# EasyEDA Pro project 硬触发测试_2024-02-21_17-27-05(1).eprj, schematic Schematic1 (continued)
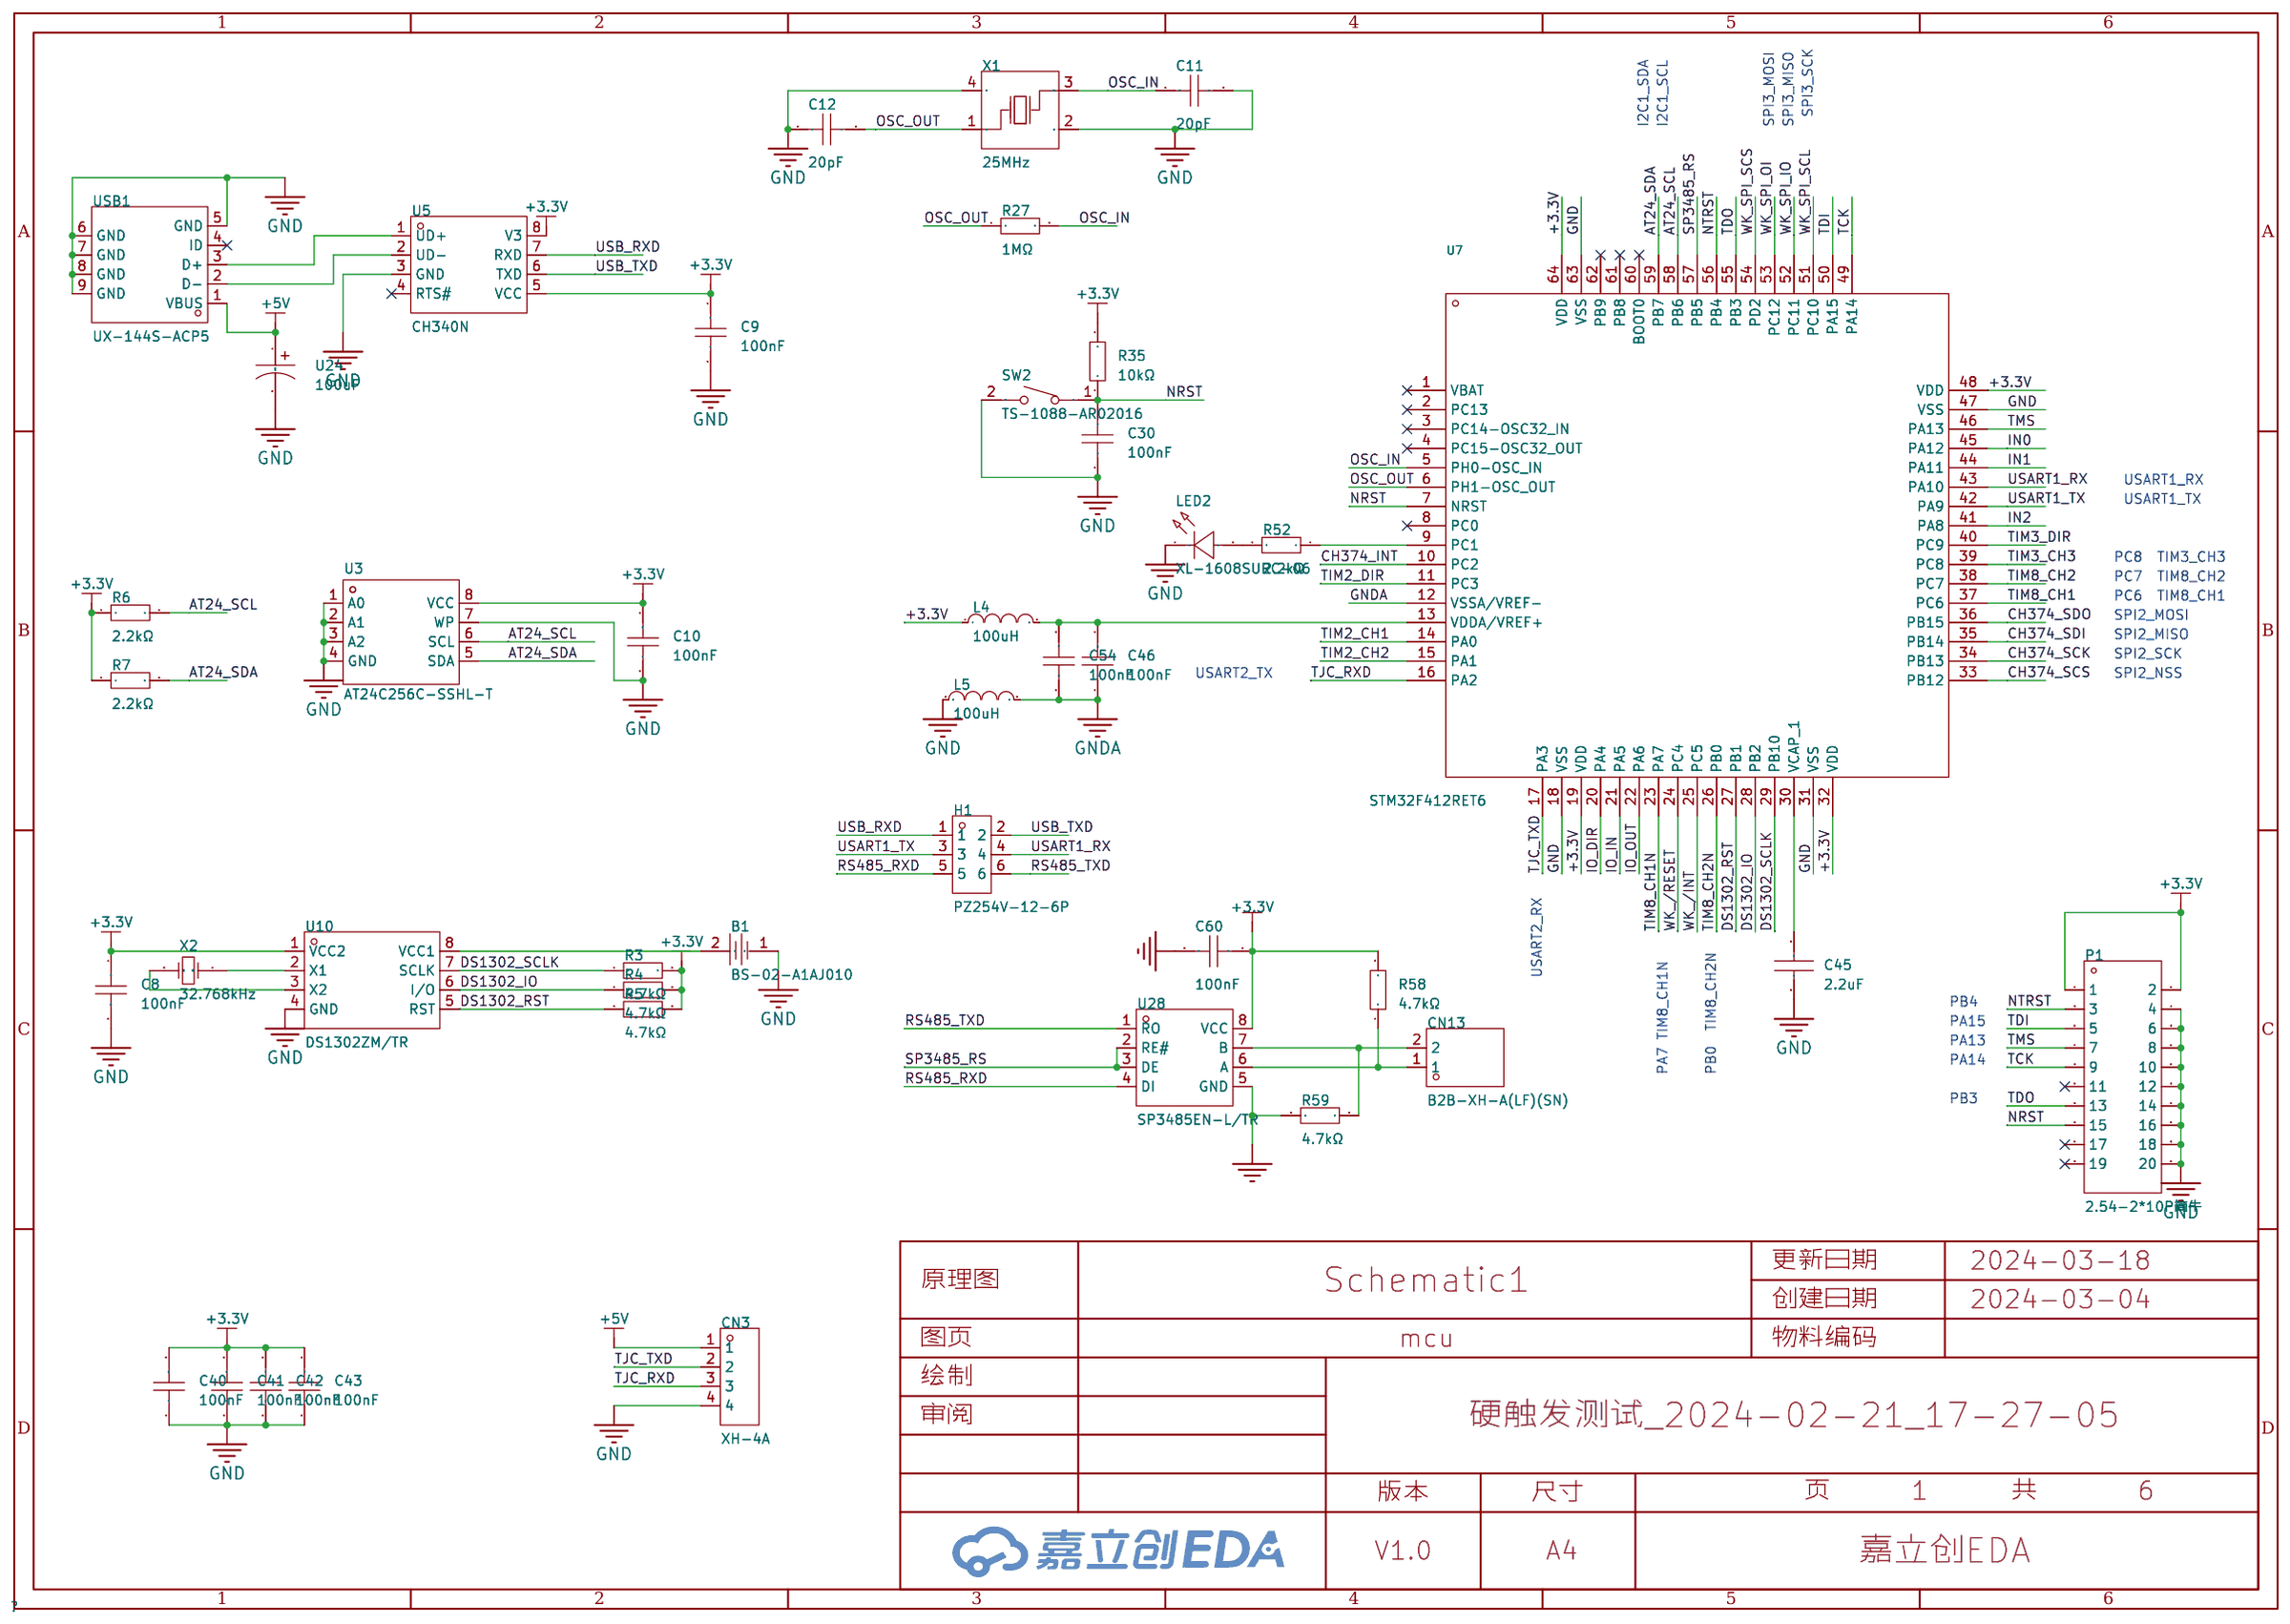
[diagram p0: mcu]
## Library data of the parts (continued)
P1 = 2.54-2*10P简牛: 连接器类型:简牛座;间距:2.54mm;封装形式:直插;行距:2.54mm;排数:2;触头材质:-;触头镀层:-;; LCSC Part Name: 2.54mm 排数:2; Supplier Part: C3405; Manufacturer: BOOMELE(博穆精密); Supplier Footprint: 插件,P=2.54mm; JLCPCB Part Class: 扩展库; Datasheet: https://atta.szlcsc.com/upload/public/pdf/source/20220902/F4C4645E59EE38C0F12B225613E1076A.pdf; Supplier: LCSC; Connector Type: 简牛座; Pitch: 2.54mm; Holder Type: 直插; Row Spacing: 2.54mm; Number of Rows: 2
R3-R5 R51 = 0603WAF4701T5E: 电阻类型:厚膜电阻;阻值:4.7kΩ;精度:±1%;功率:100mW;最大工作电压:75V;温度系数:±100ppm/℃;; LCSC Part Name: 4.7kΩ ±1% 100mW 厚膜电阻; Supplier Part: C23162; Manufacturer: UNI-ROYAL(厚声); Supplier Footprint: 0603; JLCPCB Part Class: 基础库; Datasheet: https://atta.szlcsc.com/upload/public/pdf/source/20200306/C422600_1E6D84923E4A46A82E41ADD87F860B5C.pdf; Supplier: LCSC; Type: 厚膜电阻; Tolerance: ±1%; Power(Watts): 100mW; Overload Voltage (Max): 75V; Temperature Coefficient: ±100ppm/℃; Operating Temperature Range: -55℃~+155℃
R6 R7 R42 R44-R49 R52 R55-R57 = 0603WAF2201T5E: 电阻类型:厚膜电阻;阻值:2.2kΩ;精度:±1%;功率:100mW;最大工作电压:75V;温度系数:±100ppm/℃;; LCSC Part Name: 2.2kΩ ±1% 100mW 厚膜电阻; Supplier Part: C4190; Manufacturer: UNI-ROYAL(厚声); Supplier Footprint: 0603; JLCPCB Part Class: 基础库; Datasheet: https://atta.szlcsc.com/upload/public/pdf/source/20200306/C422600_1E6D84923E4A46A82E41ADD87F860B5C.pdf; Supplier: LCSC; Type: 厚膜电阻; Tolerance: ±1%; Power(Watts): 100mW; Overload Voltage (Max): 75V; Temperature Coefficient: ±100ppm/℃; Operating Temperature Range: -55℃~+155℃
R27 R28 = 0603WAF1004T5E: 电阻类型:厚膜电阻;阻值:1MΩ;精度:±1%;功率:100mW;最大工作电压:75V;温度系数:±100ppm/℃;; LCSC Part Name: 1MΩ ±1% 100mW 厚膜电阻; Supplier Part: C22935; Manufacturer: UNI-ROYAL(厚声); Supplier Footprint: 0603; JLCPCB Part Class: 基础库; Datasheet: https://atta.szlcsc.com/upload/public/pdf/source/20200306/C422600_1E6D84923E4A46A82E41ADD87F860B5C.pdf; Supplier: LCSC; Type: 厚膜电阻; Tolerance: ±1%; Power(Watts): 100mW; Overload Voltage (Max): 75V; Temperature Coefficient: ±100ppm/℃; Operating Temperature Range: -55℃~+155℃
R1 R18-R26 R29-R35 = 0603WAF1002T5E: 电阻类型:厚膜电阻;阻值:10kΩ;精度:±1%;功率:100mW;最大工作电压:75V;温度系数:±100ppm/℃;; LCSC Part Name: 厚膜电阻 10kΩ ±1% 100mW; Supplier Part: C25804; Manufacturer: UNI-ROYAL(厚声); Supplier Footprint: 0603; JLCPCB Part Class: 基础库; Datasheet: https://atta.szlcsc.com/upload/public/pdf/source/20200306/C422600_1E6D84923E4A46A82E41ADD87F860B5C.pdf; Supplier: LCSC; Type: 厚膜电阻; Tolerance: ±1%; Power(Watts): 100mW; Overload Voltage (Max): 75V; Temperature Coefficient: ±100ppm/℃; Operating Temperature Range: -55℃~+155℃
R58 R59 = 0603WAF4701T5E: 电阻类型:厚膜电阻;阻值:4.7kΩ;精度:±1%;功率:100mW;; LCSC Part Name: 4.7kΩ ±1% 100mW; Supplier Part: C23162; Manufacturer: UNI-ROYAL(厚声); Supplier Footprint: 0603; JLCPCB Part Class: Basic Part; Datasheet: https://atta.szlcsc.com/upload/public/pdf/source/20200306/C422600_1E6D84923E4A46A82E41ADD87F860B5C.pdf; Supplier: LCSC; Type: 厚膜电阻; Tolerance: ±1%; Power(Watts): 100mW; Overload Voltage (Max): 75V; Temperature Coefficient: ±100ppm/℃; Operating Temperature Range: -55℃~+155℃
SW2 = TS-1088-AR02016: 电路结构:单刀单掷;按钮形状:圆形按钮;作用力:160gf;安装方式:立贴;开关长度:4mm;开关宽度:3mm;开关高度:2mm;带支架:不带;触点电流:50mA;额定电压(DC):12V;绝缘电阻:100MΩ;机械寿命:10万次;; LCSC Part Name: 4*3*2mm 立贴 轻触开关; Supplier Part: C720477; Manufacturer: XUNPU(讯普); Supplier Footprint: SMD; JLCPCB Part Class: 扩展库; Datasheet: https://atta.szlcsc.com/upload/public/pdf/source/20200810/C720475_60D09DD6C54279ADDB2DC25100F1CC11.pdf; Supplier: LCSC; Circuit: 单刀单掷; Actuator Style: 圆形按钮; Operating Force: 160gf; Mounting Style: 立贴; Switch Length: 4mm; Switch Width: 3mm; Switch Height: 2mm; Strike Gundam: 不带; Contact Current: 50mA; Voltage Rating (DC): 12V; Insulation Resistance: 100MΩ; Actuator/Cap Color: 黑色; Pin Style: SMD接片; Mechanical Life: 10万次; Operating Temperature: -30℃~+80℃
U3 = AT24C256C-SSHL-T: 接口类型:I2C;存储容量:256Kbit;; Supplier Part: C6482; Manufacturer: MICROCHIP(美国微芯); Supplier Footprint: SOIC-8; JLCPCB Part Class: 扩展库; Datasheet: https://atta.szlcsc.com/upload/public/pdf/source/20140704/1457707098744.pdf; Supplier: LCSC; Interface Type: I2C; Memory Size: 256Kbit; Supply Voltage: 1.7V~5.5V; Operating Temperature: -40℃~+85℃
U5 = CH340N: LCSC Part Name: USB转串口芯片 CH340; Supplier Part: C2977777; Manufacturer: WCH(南京沁恒); Supplier Footprint: SOP-8; JLCPCB Part Class: 扩展库; Datasheet: https://atta.szlcsc.com/upload/public/pdf/source/20230530/6E401E9554E9F5311886CC8B3F89B62E.pdf; Supplier: LCSC
U7 = STM32F412RET6: CPU内核:CM4;程序存储容量:512KB;RAM总容量:256KB;GPIO端口数量:50;工作电压范围:1.7V~3.6V;CPU最大主频:100MHz;程序存储器类型:FLASH;; Supplier Part: C89374; Manufacturer: ST(意法半导体); Supplier Footprint: LQFP-64(10x10); JLCPCB Part Class: 扩展库; Datasheet: https://atta.szlcsc.com/upload/public/pdf/source/20170712/C94351_1499832488194814741.pdf; Supplier: LCSC; CPU Core: CM4; Program Storage Size: 512KB; RAM Size: 256KB; GPIO Ports Number: 50; Operating Voltage Range: 1.7V~3.6V; CPU Maximum Speed: 100MHz; Program Memory Type: FLASH; Operating Temperature Range: -40℃~+85℃; ADC (Bit): 12bit; Peripheral/Function: DMA；LCD/LED驱动; Internal Oscillator: 有
U10 = DS1302ZM/TR: 工业级 具有涓细电流充电能力的低功耗实时时钟芯片; Supplier Part: C910859; Manufacturer: HGSEMI(华冠); Supplier Footprint: SOP-8; JLCPCB Part Class: 扩展库; Datasheet: https://atta.szlcsc.com/upload/public/pdf/source/20201111/C910859_921CCC6706070F058354C83BA711E7C3.pdf; Supplier: LCSC
U24 U25 = CK1A101M-CRD54_C3001231: 容值:100uF;精度:±20%;额定电压:10V;纹波电流:40mA@120Hz;; LCSC Part Name: 100uF ±20% 10V; Supplier Part: C3001231; Manufacturer: ROQANG(容强); Manufacturer Part: CK1A101M-CRD54; Supplier Footprint: SMD,D5xL5.4mm; JLCPCB Part Class: 扩展库; Datasheet: https://atta.szlcsc.com/upload/public/pdf/source/20220429/3961170169213FF6C34E47C660BD429F.pdf; Supplier: LCSC; Tolerance: ±20%; Rated Voltage: 10V; Ripple Current: 40mA@120Hz; φD: 5mm; L: 5.4mm; Lifetime @ Temp: 2000hrs@105℃; Operating Temperature: -40℃~+105℃
U28 = SP3485EN-L/TR: 类型:收发器;驱动器/接收器:1/1;数据速率:10Mbps;; LCSC Part Name: 3.3V供电 10Mbps 收发器; Supplier Part: C8963; Manufacturer: MaxLinear; Supplier Footprint: SOIC-8; JLCPCB Part Class: Basic Part; Datasheet: https://atta.szlcsc.com/upload/public/pdf/source/20170601/1496285796963.pdf; Supplier: LCSC; Types: 收发器; Driver/receiver: 1/1; Data Rate: 10Mbps; Supply Voltage: 3.3V
USB1 = UX-144S-ACP5: 连接器类型:Mini-B;标准:USB 2.0;公母:母;端口数量:1;触点数量:5P;安装方式:卧贴;额定电流 - 电源:1.5A;工作温度范围:-20℃~+70℃;焊接温度(最大值):260℃;; LCSC Part Name: Mini-B 母 卧贴; Supplier Part: C720611; Manufacturer: XUNPU(讯普); Supplier Footprint: SMD; JLCPCB Part Class: 扩展库; Datasheet: https://atta.szlcsc.com/upload/public/pdf/source/20200812/C720611_E8490E4C4B00597353DD684194E98629.pdf; Supplier: LCSC; Connector Type: Mini-B; Standard: USB 2.0; Gender: 母; Number of Ports: 1; Number of Contacts: 5P; Mounting Style: 卧贴; Current Rating - Power (Max): 1.5A; Operating Temperature Range: -20℃~+70℃; Soldering Temperature(Max): 260℃
X1 X3 = X322525MSB4SI: 晶振类型:贴片晶振;频率:25MHz;常温频差:±10ppm;外接负载电容:20pF;频率稳定度(全温):±30ppm;; LCSC Part Name: 25MHz ±10ppm 20pF; Supplier Part: C13740; Manufacturer: YXC(扬兴晶振); Supplier Footprint: SMD3225-4P; JLCPCB Part Class: 扩展库; Datasheet: https://atta.szlcsc.com/upload/public/pdf/source/20210329/C112971_1F611BDC486E193C1706F6D8EB5AA189.pdf; Supplier: LCSC; Crystal Type: 贴片晶振; Normal temperature Frequency Tolerance: ±10ppm; External load capacitor: 20pF; Frequency Stability(Full temperature range): ±30ppm; Operating Temperature: -40℃~+85℃
X2 = X206032768KGB2SC: 晶振类型:直插晶振;频率:32.768kHz;常温频差:±10ppm;外接负载电容:12.5pF;; LCSC Part Name: 32.768kHz ±10ppm 12.5pF YT-26; Supplier Part: C2236; Manufacturer: YXC(扬兴晶振); Supplier Footprint: DT-26; JLCPCB Part Class: 扩展库; Datasheet: https://atta.szlcsc.com/upload/public/pdf/source/20210329/C13712_F7F11DC87370623B2CDEB0B445E6F76E.pdf; Supplier: LCSC; Crystal Type: 直插晶振; Normal temperature Frequency Tolerance: ±10ppm; External load capacitor: 12.5pF; Operating Temperature: -20℃~+70℃
C31 C32 = 0402CG120J500NT: 容值:12pF;精度:±5%;额定电压:50V;材质(温度系数):C0G;; LCSC Part Name: 12pF ±5% 50V; Supplier Part: C1547; Manufacturer: FH(风华); Supplier Footprint: 0402; JLCPCB Part Class: 基础库; Datasheet: https://atta.szlcsc.com/upload/public/pdf/source/20200305/C486355_26A10D38EF8C2A5C37091D0039909270.pdf; Supplier: LCSC; Tolerance: ±5%; Voltage Rated: 50V; Temperature Coefficient: C0G
U14 = CH374T: 应用功能:收发器;接口协议:USB 2.0;数据速率:12Mbps;; Supplier Part: C81627; Manufacturer: WCH(南京沁恒); Supplier Footprint: SSOP-20-208mil; JLCPCB Part Class: 扩展库; Datasheet: https://atta.szlcsc.com/upload/public/pdf/source/20200819/C81627_DDBB013DAD1520FD3FA49638DA03CE5E.pdf; Supplier: LCSC; Applications Function: 收发器; Protocol: USB 2.0; Supply Voltage: 3.3V；5V; Data Rate: 12Mbps
USB2 = USB-231-ARY: 连接器类型:Type-A;标准:USB 2.0;公母:母;端口数量:1;触点数量:4P;安装方式:弯插;额定电流 - 电源:1.5A;触头材质:-;触头镀层:-;工作温度范围:-20℃~+70℃;焊接温度(最大值):260℃;; LCSC Part Name: Type-A 母 弯插; Supplier Part: C720525; Manufacturer: XUNPU(讯普); Supplier Footprint: 插件; JLCPCB Part Class: 扩展库; Datasheet: https://atta.szlcsc.com/upload/public/pdf/source/20200810/C720525_A4C9C15D608FF9239C9C137FD959DB52.pdf; Supplier: LCSC; Connector Type: Type-A; Standard: USB 2.0; Gender: 母; Number of Ports: 1; Number of Contacts: 4P; Mounting Style: 弯插; Current Rating - Power (Max): 1.5A; Operating Temperature Range: -20℃~+70℃; Soldering Temperature(Max): 260℃
X4 = X322524MOB4SI: 晶振类型:贴片晶振;频率:24MHz;常温频差:±10ppm;外接负载电容:12pF;频率稳定度(全温):±30ppm;; LCSC Part Name: 24MHz ±10ppm 12pF; Supplier Part: C70590; Manufacturer: YXC(扬兴晶振); Supplier Footprint: SMD3225-4P; JLCPCB Part Class: 扩展库; Datasheet: https://atta.szlcsc.com/upload/public/pdf/source/20230512/FCFA71FC9F356FF871B9CC5C5DAC5D5F.pdf; Supplier: LCSC; Crystal Type: 贴片晶振; Normal temperature Frequency Tolerance: ±10ppm; External load capacitor: 12pF; Frequency Stability(Full temperature range): ±30ppm; Operating Temperature: -40℃~+85℃
C1 C20 C24 = CC0603KRX7R9BB103: 容值:10nF;精度:±10%;额定电压:50V;材质(温度系数):X7R;; LCSC Part Name: 10nF ±10% 50V; Supplier Part: C100042; Manufacturer: YAGEO(国巨); Supplier Footprint: 0603; JLCPCB Part Class: 扩展库; Datasheet: https://atta.szlcsc.com/upload/public/pdf/source/20181008/C309510_22F155564471FAF6A489F7D68F34234E.pdf; Supplier: LCSC; Tolerance: ±10%; Voltage Rated: 50V; Temperature Coefficient: X7R
C4 C5 C13 = CL31A106KBHNNNE: 容值:10uF;精度:±10%;额定电压:50V;材质(温度系数):X5R;; LCSC Part Name: 10uF ±10% 50V; Supplier Part: C13585; Manufacturer: SAMSUNG(三星); Supplier Footprint: 1206; JLCPCB Part Class: 基础库; Datasheet: https://atta.szlcsc.com/upload/public/pdf/source/20160218/1457707763339.pdf; Supplier: LCSC; Tolerance: ±10%; Voltage Rated: 50V; Temperature Coefficient: X5R
C36 = CL21A106KAYNNNE_C15850: 容值:10uF;精度:±10%;额定电压:25V;材质(温度系数):X5R;; LCSC Part Name: 10uF ±10% 25V; Supplier Part: C15850; Manufacturer: SAMSUNG(三星); Manufacturer Part: CL21A106KAYNNNE; Supplier Footprint: 0805; JLCPCB Part Class: 基础库; Datasheet: https://atta.szlcsc.com/upload/public/pdf/source/20160218/1457707763339.pdf; Supplier: LCSC; Tolerance: ±10%; Voltage Rated: 25V; Temperature Coefficient: X5R
C37 C38 = RVT470UF35V67RV0056: 容值:470uF;精度:±20%;额定电压:35V;纹波电流:286mA@120Hz;等效串联电阻:-;; LCSC Part Name: 470uF ±20% 35V; Supplier Part: C2836436; Manufacturer: KNSCHA(科尼盛); Supplier Footprint: SMD,D10xL10.2mm; JLCPCB Part Class: 扩展库; Datasheet: https://atta.szlcsc.com/upload/public/pdf/source/20210528/C2836436_C8D3EEA5E3C1CA7F9FA48FC22CF12531.pdf; Supplier: LCSC; Tolerance: ±20%; Rated Voltage: 35V; Ripple Current: 286mA@120Hz; φD: 10mm; L: 10.2mm; Lifetime @ Temp: 2000hrs@105℃; Operating Temperature: -55℃~+105℃
C52 C53 C55 = RVT1A221M0605_C72494: 容值:220uF;精度:±20%;额定电压:10V;纹波电流:90mA@120Hz;等效串联电阻:-;; LCSC Part Name: 220uF ±20% 10V; Supplier Part: C72494; Manufacturer: ROQANG(容强); Manufacturer Part: RVT1A221M0605; Supplier Footprint: SMD,D6.3xL5.4mm; JLCPCB Part Class: 扩展库; Datasheet: https://atta.szlcsc.com/upload/public/pdf/source/20170325/1490427950282.pdf; Supplier: LCSC; Tolerance: ±20%; Rated Voltage: 10V; Ripple Current: 90mA@120Hz; φD: 6.3mm; L: 5.4mm; Lifetime @ Temp: 2000hrs@105℃; Operating Temperature: -40℃~+105℃
CN1 CN2 CN4 = XY118-5.0-2P: 结构:1x2P;间距:5mm;颜色:蓝色;安装类型:通孔;总PIN数:2P;每排PIN数:2;额定电流:8A;额定电压:300V;线规 - AWG:18~22;线规 - 平方毫米:1;工作温度范围:-;排数:1;; LCSC Part Name: 5mm 1x2P 每排P数:2 排数:1; Supplier Part: C784922; Manufacturer: XINLAIYA(新莱亚); Supplier Footprint: 插件,P=5mm; JLCPCB Part Class: 扩展库; Datasheet: https://atta.szlcsc.com/upload/public/pdf/source/20200917/C784922_D4A3F3BA711ADAE0760F3AD631E576B1.pdf; Supplier: LCSC; Structure: 1x2P; Pitch: 5mm; Color: 蓝色; Mounting Style: 通孔; Number of Pins: 2P; Number of PINs Per Row: 2; Current Rating (Max): 8A; Voltage Rating (Max): 300V; Wire Gauge - AWG: 18~22; Wire Gauge - mm2: 1; Number of Rows: 1
D1 = B340A_C3018525: 正向压降(Vf):550mV@3A;直流反向耐压(Vr):40V;平均整流电流(Io):3A;; LCSC Part Name: 电压:40V 电流:3A; Supplier Part: C3018525; Manufacturer: FUXINSEMI(富芯森美); Supplier Footprint: SMA(DO-214AC); JLCPCB Part Class: 扩展库; Datasheet: https://atta.szlcsc.com/upload/public/pdf/source/20220530/48889337C27311960E6F9D350CFD44EF.pdf; Supplier: LCSC; Forward Voltage (Vf@If): 550mV@3A; Reverse Voltage (Vr): 40V; Average Rectified Current (Io): 3A; Reverse Leakage Current (Ir): 500uA@40V
D2 = SS34_C8678: 二极管配置:独立式;正向压降(Vf):550mV@3A;直流反向耐压(Vr):40V;平均整流电流(Io):3A;; LCSC Part Name: 电压:40V 电流:3A; Supplier Part: C8678; Manufacturer: MDD; Supplier Footprint: SMA(DO-214AC); JLCPCB Part Class: 基础库; Datasheet: https://atta.szlcsc.com/upload/public/pdf/source/20230314/A80AE34493C69B89E2F4B1712F433538.pdf; Supplier: LCSC; Diode Configuration: 独立式; Forward Voltage (Vf@If): 550mV@3A; Reverse Voltage (Vr): 40V; Average Rectified Current (Io): 3A; Reverse Leakage Current (Ir): 500uA@40V
L1 = SWPA8040S150MT: 电感值:15uH;精度:±20%;额定电流:2.6A;饱和电流(Isat):3.4A;类型:-;; LCSC Part Name: 15uH ±20% 3.4A; Supplier Part: C16853; Manufacturer: Sunlord(顺络); Supplier Footprint: SMD; JLCPCB Part Class: 扩展库; Datasheet: https://atta.szlcsc.com/upload/public/pdf/source/20231024/317626D2AA2F8AB4113C1875E432E6E1.pdf; Supplier: LCSC; Tolerance: ±20%; Rated Current: 2.6A; Saturation Current (Isat): 3.4A; DC Resistance (DCR): 47mΩ
L2 = UU9.8-10mH: 线路数:2;电感 @ 频率:10mH@1kHz;阻抗 @ 频率:-;直流电阻(DCR):800mΩ;; LCSC Part Name: 两路 插件共模滤波器; Supplier Part: C148474; Manufacturer: FH(风华); Supplier Footprint: 插件; JLCPCB Part Class: 扩展库; Datasheet: https://atta.szlcsc.com/upload/public/pdf/source/20210713/C148474_656501625637B4BA0D3972AB204D3908.pdf; Supplier: LCSC; Number of Lines: 2; Withstanding Voltage: 1kV; Inductance @ Frequency: 10mH@1kHz; DC Resistance (DCR): 800mΩ
R2 = 0603WAF3241T5E: 电阻类型:厚膜电阻;阻值:3.24kΩ;精度:±1%;功率:100mW;最大工作电压:75V;温度系数:±100ppm/℃;; LCSC Part Name: 3.24kΩ ±1% 100mW 厚膜电阻; Supplier Part: C22994; Manufacturer: UNI-ROYAL(厚声); Supplier Footprint: 0603; JLCPCB Part Class: 扩展库; Datasheet: https://atta.szlcsc.com/upload/public/pdf/source/20200306/C422600_1E6D84923E4A46A82E41ADD87F860B5C.pdf; Supplier: LCSC; Type: 厚膜电阻; Tolerance: ±1%; Power(Watts): 100mW; Overload Voltage (Max): 75V; Temperature Coefficient: ±100ppm/℃; Operating Temperature Range: -55℃~+155℃
U4 U12 = AMS1117-3.3_C347222: 输出类型:固定;最大输入电压:18V;输出电压:3.3V;最大输出电流:1A;电源纹波抑制比(PSRR):60dB@(120Hz);输出极性:正极;; LCSC Part Name: 输入18V 输出3.3V 1A; Supplier Part: C347222; Manufacturer: UMW(友台半导体); Supplier Footprint: SOT-223; JLCPCB Part Class: 扩展库; Datasheet: https://atta.szlcsc.com/upload/public/pdf/source/20231109/155D79A26D9DB04352555A58D5969DC8.pdf; Supplier: LCSC; Output Type: 固定; Maximum Input Voltage: 18V; Output Voltage: 3.3V; MAX Output Current: 1A; Power Supply Rejection Ratio (PSRR): 60dB@(120Hz); Dropout Voltage: 1.3V@(1A); Output Polarity: 正极; Number of Outputs: 1
U11 = TPS5430DDAR: 功能类型:降压型;输出类型:可调;输入电压:5.5V~36V;输出电压:1.221V~32.04V;输出电流(最大值):3A;; LCSC Part Name: 降压 3A 36V; Supplier Part: C9864; Manufacturer: TI(德州仪器); Supplier Footprint: SOIC-8-EP; JLCPCB Part Class: 基础库; Datasheet: https://www.ti.com/cn/lit/gpn/tps5430; Supplier: LCSC; Function: 降压型; Output Type: 可调; Input Voltage: 5.5V~36V; Output Voltage: 1.221V~32.04V; Output Current (Max): 3A; Switching Frequency: 500kHz; Operating Temperature: -40℃~+125℃@(TJ); Synchronous Rectification: 否; Number of Outputs: 1; Topology: 降压式; Switch tube (built-in/external): 内置
U13 = YL160808-1R0K: 电感值:1uH;精度:±10%;额定电流:25mA;饱和电流(Isat):-;直流电阻(DCR):600mΩ;; LCSC Part Name: 1uH ±10%; Supplier Part: C2839970; Manufacturer: YJYCOIN(益嘉源); Supplier Footprint: 0603; JLCPCB Part Class: 扩展库; Datasheet: https://atta.szlcsc.com/upload/public/pdf/source/20210615/C2839970_ABC794F14AEDE076178322CDBBF81D48.pdf; Supplier: LCSC; Tolerance: ±10%; Rated Current: 25mA; DC Resistance (DCR): 600mΩ; Q @ Freq: 35@10MHz; Frequency - Self Resonant: 75MHz
C16 = 0603B223K500NT: 容值:22nF;精度:±10%;额定电压:50V;材质(温度系数):X7R;; LCSC Part Name: 22nF ±10% 50V; Supplier Part: C77571; Manufacturer: FH(风华); Supplier Footprint: 0603; JLCPCB Part Class: 扩展库; Datasheet: https://atta.szlcsc.com/upload/public/pdf/source/20200305/C486355_26A10D38EF8C2A5C37091D0039909270.pdf; Supplier: LCSC; Tolerance: ±10%; Voltage Rated: 50V; Temperature Coefficient: X7R
C18 C19 = CC0603KRX7R9BB682: 容值:6.8nF;精度:±10%;额定电压:50V;材质(温度系数):X7R;; LCSC Part Name: 6.8nF ±10% 50V; Supplier Part: C107097; Manufacturer: YAGEO(国巨); Supplier Footprint: 0603; JLCPCB Part Class: 扩展库; Datasheet: https://atta.szlcsc.com/upload/public/pdf/source/20180910/C282072_33301C7F631E79921B82A8DAC6BCC5B3.pdf; Supplier: LCSC; Tolerance: ±10%; Voltage Rated: 50V; Temperature Coefficient: X7R
C23 = CL10A475KP8NNNC: 容值:4.7uF;精度:±10%;额定电压:10V;材质(温度系数):X5R;; LCSC Part Name: 4.7uF ±10% 10V; Supplier Part: C1705; Manufacturer: SAMSUNG(三星); Supplier Footprint: 0603; JLCPCB Part Class: 扩展库; Datasheet: https://atta.szlcsc.com/upload/public/pdf/source/20160218/1457707763339.pdf; Supplier: LCSC; Tolerance: ±10%; Voltage Rated: 10V; Temperature Coefficient: X5R
C27 C28 = 0402CG180J500NT: 容值:18pF;精度:±5%;额定电压:50V;材质(温度系数):C0G;; LCSC Part Name: 18pF ±5% 50V; Supplier Part: C1549; Manufacturer: FH(风华); Supplier Footprint: 0402; JLCPCB Part Class: 基础库; Datasheet: https://atta.szlcsc.com/upload/public/pdf/source/20200305/C486355_26A10D38EF8C2A5C37091D0039909270.pdf; Supplier: LCSC; Tolerance: ±5%; Voltage Rated: 50V; Temperature Coefficient: C0G
J1 = HR911105A_C12074: 连接器类型:RJ插座;USOC代码:RJ45;端口数量:1;屏蔽:-;LED:带LED;等级:-;; LCSC Part Name: RJ45 带LED; Supplier Part: C12074; Manufacturer: HANRUN(汉仁); Supplier Footprint: 插件; JLCPCB Part Class: 扩展库; Datasheet: https://atta.szlcsc.com/upload/public/pdf/source/20170918/C12074_1505726819496976146.pdf; Supplier: LCSC; Connector Type: RJ插座; USOC Codes: RJ45; Number of Ports: 1; LED: 带LED
R8 R9 R53 R54 = 0603WAF1001T5E: 电阻类型:厚膜电阻;阻值:1kΩ;精度:±1%;功率:100mW;最大工作电压:75V;温度系数:±100ppm/℃;; LCSC Part Name: 1kΩ ±1% 100mW 厚膜电阻; Supplier Part: C21190; Manufacturer: UNI-ROYAL(厚声); Supplier Footprint: 0603; JLCPCB Part Class: 基础库; Datasheet: https://atta.szlcsc.com/upload/public/pdf/source/20200306/C422600_1E6D84923E4A46A82E41ADD87F860B5C.pdf; Supplier: LCSC; Type: 厚膜电阻; Tolerance: ±1%; Power(Watts): 100mW; Overload Voltage (Max): 75V; Temperature Coefficient: ±100ppm/℃; Operating Temperature Range: -55℃~+155℃
R10 R11 = 0603WAF510JT5E: 电阻类型:厚膜电阻;阻值:51Ω;精度:±1%;功率:100mW;最大工作电压:75V;温度系数:±100ppm/℃;; LCSC Part Name: 51Ω ±1% 100mW 厚膜电阻; Supplier Part: C23197; Manufacturer: UNI-ROYAL(厚声); Supplier Footprint: 0603; JLCPCB Part Class: 基础库; Datasheet: https://atta.szlcsc.com/upload/public/pdf/source/20200306/C422600_1E6D84923E4A46A82E41ADD87F860B5C.pdf; Supplier: LCSC; Type: 厚膜电阻; Tolerance: ±1%; Power(Watts): 100mW; Overload Voltage (Max): 75V; Temperature Coefficient: ±100ppm/℃; Operating Temperature Range: -55℃~+155℃
R14 = 0603WAF100JT5E: 电阻类型:厚膜电阻;阻值:10Ω;精度:±1%;功率:100mW;最大工作电压:75V;温度系数:±400ppm/℃;; LCSC Part Name: 10Ω ±1% 100mW 厚膜电阻; Supplier Part: C22859; Manufacturer: UNI-ROYAL(厚声); Supplier Footprint: 0603; JLCPCB Part Class: 基础库; Datasheet: https://atta.szlcsc.com/upload/public/pdf/source/20200306/C422600_1E6D84923E4A46A82E41ADD87F860B5C.pdf; Supplier: LCSC; Type: 厚膜电阻; Tolerance: ±1%; Power(Watts): 100mW; Overload Voltage (Max): 75V; Temperature Coefficient: ±400ppm/℃; Operating Temperature Range: -55℃~+155℃
R15 R16 = 0603WAF820JT5E: 电阻类型:厚膜电阻;阻值:82Ω;精度:±1%;功率:100mW;最大工作电压:75V;温度系数:±100ppm/℃;; LCSC Part Name: 82Ω ±1% 100mW 厚膜电阻; Supplier Part: C23255; Manufacturer: UNI-ROYAL(厚声); Supplier Footprint: 0603; JLCPCB Part Class: 扩展库; Datasheet: https://atta.szlcsc.com/upload/public/pdf/source/20200306/C422600_1E6D84923E4A46A82E41ADD87F860B5C.pdf; Supplier: LCSC; Type: 厚膜电阻; Tolerance: ±1%; Power(Watts): 100mW; Overload Voltage (Max): 75V; Temperature Coefficient: ±100ppm/℃; Operating Temperature Range: -55℃~+155℃
R17 = 0603WAF1242T5E: 电阻类型:厚膜电阻;阻值:12.4kΩ;精度:±1%;功率:100mW;最大工作电压:75V;温度系数:±100ppm/℃;; LCSC Part Name: 12.4kΩ ±1% 100mW 厚膜电阻; Supplier Part: C22865; Manufacturer: UNI-ROYAL(厚声); Supplier Footprint: 0603; JLCPCB Part Class: 扩展库; Datasheet: https://atta.szlcsc.com/upload/public/pdf/source/20200306/C422600_1E6D84923E4A46A82E41ADD87F860B5C.pdf; Supplier: LCSC; Type: 厚膜电阻; Tolerance: ±1%; Power(Watts): 100mW; Overload Voltage (Max): 75V; Temperature Coefficient: ±100ppm/℃; Operating Temperature Range: -55℃~+155℃
U2 = W5500: 应用功能:控制器;通道数:-;接口类型:SPI;; LCSC Part Name: 硬连线TCP/IP嵌入式以太网控制器; Supplier Part: C32843; Manufacturer: WIZNET; Supplier Footprint: LQFP-48(7x7); JLCPCB Part Class: 扩展库; Datasheet: https://atta.szlcsc.com/upload/public/pdf/source/20230714/E10C32B058E0BA54FCE1C1556BE10C07.pdf; Supplier: LCSC; Application Function: 控制器; Interface: SPI; Supply Voltage: 2.97V~3.63V; Supply Current: 132mA; Operating Temperature: -40℃~+85℃
CN11 CN12 = XH-4AW_C21273: 插针结构:1x4P;间距:2.5mm;安装方式:弯插;参考系列:XH;总PIN数:4P;排数:1;每排PIN数:4;行距:-;触头材质:磷青铜;; LCSC Part Name: 系列:XH 间距:2.5mm 1x4P; Supplier Part: C21273; Manufacturer: BOOMELE(博穆精密); Supplier Footprint: 弯插,P=2.5mm; JLCPCB Part Class: 扩展库; Datasheet: https://atta.szlcsc.com/upload/public/pdf/source/20181205/C146112_2CB31444E6250AC61E2A41A9A8391D5F.pdf; Supplier: LCSC; Pins Structure: 1x4P; Pitch: 2.5mm; Mounting Style: 弯插; Reference Series: XH; Number of Pins: 4P; Number of Rows: 1; Number of PINs Per Row: 4; Contact Material: 磷青铜
U9 U16 U26 U27 = SN74LVC2T45DCUR: SN74LVC2T45 具有可配置电压转换和三态输出的 2 位双电源总线收发器; Supplier Part: C15741; Manufacturer: TI(德州仪器); Supplier Footprint: VSSOP-8-0.5mm; JLCPCB Part Class: 扩展库; Datasheet: https://www.ti.com/cn/lit/gpn/sn74lvc2t45; Supplier: LCSC
U20 = SN74LVC1T45DBVR: 数据速率:420Mbps;电压(VCCA):1.65V~5.5V;电压(VCCB):1.65V~5.5V;电路数:1;每个电路通道数:1;; Supplier Part: C7843; Manufacturer: TI(德州仪器); Supplier Footprint: SOT-23-6; JLCPCB Part Class: 扩展库; Datasheet: https://www.ti.com/cn/lit/gpn/sn74lvc1t45; Supplier: LCSC; Channel Type: 双向; Data Rate: 420Mbps; Supply Voltage (VCCA): 1.65V~5.5V; Supply Voltage (VCCB): 1.65V~5.5V; Number of Circuits: 1; Channels per Circuit: 1; Output Type: 非反相；三态; Operating Temperature: -40℃~+85℃
U21-U23 = EL357N(C)(TA)-G: 输入电压类型:DC;正向电压:1.2V;输出电流:50mA;隔离电压(rms):3.75kV;反向电压:6V;接收端电压:80V;输出通道数:1;集射极饱和电压(Vce(sat)@Ic,IF):100mV@1mA,20mA;; LCSC Part Name: DC输入 隔离电压(rms):3750V; Supplier Part: C29981; Manufacturer: EVERLIGHT(亿光); Supplier Footprint: SOP-4-2.54mm; JLCPCB Part Class: 基础库; Datasheet: https://atta.szlcsc.com/upload/public/pdf/source/20150504/1457707280393.pdf; Supplier: LCSC; Input voltage type: DC; Output Type: 光电三极管; Forward Voltage: 1.2V; Output Current: 50mA; Isolation Voltage(rms): 3.75kV; Reverse Voltage: 6V; Receiving End Voltage: 80V; Number of Outputs: 1; Collector-Emitter Saturation Voltage (Vce(sat)@Ic,IF): 100mV@1mA,20mA; Rise time: 3us@2mA,100Ω; Fall time: 4us@2mA,100Ω; Operating Temperature: -55℃~+110℃
SW1 = SS12D07VG4 087: 电路结构:单刀双掷;安装方式:直插;开关颜色:-;额定电流(DC):500mA;额定电压(DC):50V;额定电流(AC):-;额定电压(AC):-;机械寿命:5千次;; Supplier Part: C2939726; Manufacturer: SHOU HAN(首韩); Supplier Footprint: 插件; JLCPCB Part Class: 扩展库; Datasheet: https://atta.szlcsc.com/upload/public/pdf/source/20220106/E715996F66241B9FD900079FF66489BE.pdf; Supplier: LCSC; Circuit: 单刀双掷; Pin Style: PC引脚; Switch Length: 8.7mm; Switch Width: 4.4mm; Switch Height: 4.7mm; Mounting Style: 直插; Current Rating (DC): 500mA; Voltage Rating (DC): 50V; Mechanical Life: 5千次; Operating Temperature: -10℃~+50℃

## Nets
+3.3V: C6.2 C8.1 C9.1 C10.1 C29.1 C33.1 C34.1 C40.2 C41.2 C42.2 C43.2 C52.1 C58.1 C59.2 C60.1 L4.1 P1.1 P1.2 R3.2 R4.2 R5.2 R6.1 R7.1 R35.2 R42.2 R44.2 R46.2 R48.2 R53.1 R54.1 R55.2 R56.2 R57.2 R58.2 SW1.3 U3.8(VCC) U4.2(VOUT(TAB)) U4.4(TAB) U5.5(VCC) U5.8(V3) U7.19(VDD) U7.32(VDD) U7.48(VDD) U7.64(VDD) U9.1(VCCA) U10.1(VCC2) U14.5(V3) U14.19(CS#) U14.20(VCC) U16.1(VCCA) U20.1(VCCA) U26.1(VCCA) U27.1(VCCA) U28.8(VCC)
+5V: C5.2 C13.2 C55.1 C56.2 C57.2 CN3.1 L1.2 R1.2 SW1.1 U4.3(VIN) U12.3(VIN) U16.8(VCCB) U20.6(VCCB) U24.1 U25.1 U26.8(VCCB) U27.8(VCCB) USB1.1(VBUS) USB2.1(VBUS)
GND: B1.1 C4.1 C5.1 C6.1 C8.2 C9.2 C10.2 C11.2 C12.1 C13.1 C14.1 C16.2 C17.2 C20.2 C21.1 C22.1 C23.1 C24.1 C27.2 C28.1 C29.2 C30.2 C31.1 C32.1 C33.2 C34.2 C37.2 C38.2 C40.1 C41.1 C42.1 C43.1 C45.1 C52.2 C53.2 C55.2 C56.1 C57.1 C58.2 C59.1 C60.2 CN1.2 CN2.2 CN3.4 CN12.4 D1.2(A) J1.SH1 J1.SH2 L2.3 L5.1 LED2.1(K) P1.4 P1.6 P1.8 P1.10 P1.12 P1.14 P1.16 P1.18 P1.20 R2.1 R17.1 R18.1 R22.2 R23.2 R24.2 R25.2 R26.2 R29.1 R30.1 R31.1 R59.2 SW1.4 SW1.5 SW2.2 U2.3(AGND) U2.9(AGND) U2.14(AGND) U2.16(AGND) U2.19(AGND) U2.29(GND) U2.48(AGND) U3.1(A0) U3.2(A1) U3.3(A2) U3.4(GND) U3.7(WP) U4.1(ADJ(GND)) U5.3(GND) U7.18(VSS) U7.31(VSS) U7.47(VSS) U7.63(VSS) U9.4(GND) U10.4(GND) U11.6(GND) U11.9(PowerPAD) U12.1(ADJ(GND)) U14.2(WR#) U14.3(RD#) U14.18(GND) U16.4(GND) U20.2(GND) U21.3(EM) U22.3(EM) U23.3(EM) U24.2 U25.2 U26.4(GND) U27.4(GND) U28.5(GND) USB1.5(GND) USB1.6(GND) USB1.7(GND) USB1.8(GND) USB1.9(GND) USB2.4(GND) USB2.5(GND) USB2.6(GND) X1.2(GND) X1.4(GND) X3.2(GND) X3.4(GND) X4.2(GND) X4.4(GND)
GNDA: C46.1 C54.1 L5.2 U7.12(VSSA/VREF-)
VCC_IN: C4.2 D2.1(K) U11.7(VIN)
+IN0: CN5.1 R45.2
+IN1: CN6.1 R47.2
+IN2: CN7.1 R49.2
-IN0: CN5.2 U21.2(CAT)
-IN1: CN6.2 U22.2(CAT)
-IN2: CN7.2 U23.2(CAT)
ACTLED: J1.10 U2.27(ACTLED)
AT24_SCL: R6.2 U3.6(SCL) U7.58(PB6)
AT24_SDA: R7.2 U3.5(SDA) U7.59(PB7)
CH374_INT: U7.10(PC2) U14.1(INT#)
CH374_SCK: U7.34(PB13) U14.15(SCK/D5)
CH374_SCS: U7.33(PB12) U14.13(SCS/D3)
CH374_SDI: U7.35(PB14) U14.16(SDI/D6)
CH374_SDO: U7.36(PB15) U14.17(SDO/D7)
CH374T_XI: C32.2 U14.8(XI) X4.1(OSC1)
CH374T_XO: C31.2 U14.9(XO) X4.3(OSC2)
DS1302_IO: R4.1 U7.28(PB2) U10.6(I/O)
DS1302_RST: R5.1 U7.27(PB1) U10.5(RST)
DS1302_SCLK: R3.1 U7.29(PB10) U10.7(SCLK)
IN0: R48.1 U7.45(PA12) U23.4(COL)
IN1: R46.1 U7.44(PA11) U22.4(COL)
IN2: R44.1 U7.41(PA8) U21.4(COL)
IO_DIR: U7.20(PA4) U9.5(DIR)
IO_IN: U7.21(PA5) U9.2(A1)
IO_OUT: U7.22(PA6) U9.3(A2)
LINKLED: J1.11 U2.25(LINKLED)
NRST: C30.1 P1.15 R35.1 SW2.1 U7.7(NRST)
NTRST: P1.3 U7.56(PB4)
OSC_IN: C11.1 R27.2 U7.5(PH0-OSC_IN) X1.3(OSC2)
OSC_OUT: C12.2 R27.1 U7.6(PH1-OSC_OUT) X1.1(OSC1)
OUT1: CN11.1 U26.7(B1)
OUT2: CN11.2 U26.6(B2)
OUT3: CN11.3 U27.7(B1)
OUT4: CN11.4 U27.6(B2)
PMODE0: R29.2 R32.1 U2.45(PMODE0)
PMODE1: R30.2 R33.1 U2.44(PMODE1)
PMODE2: R31.2 R34.1 U2.43(PMODE2)
RCT: C20.1 J1.5 R15.2 R16.2
RS485_RXD: H1.5 U28.4(DI)
RS485_TXD: H1.6 U28.1(RO)
RXN: C19.1 R16.1 U2.5(RXN)
RXNNET: C19.2 J1.6(RD-)
RXP: C18.1 R15.1 U2.6(RXP)
RXPNET: C18.2 J1.3(RD+)
SP3485_RS: U7.57(PB5) U28.2(RE#) U28.3(DE)
TCK: P1.9 U7.49(PA14)
TCT: C16.1 J1.4 R14.2
TDI: P1.5 U7.50(PA15)
TDO: P1.13 U7.55(PB3)
TIM2_CH1: U7.14(PA0) U16.2(A1)
TIM2_CH2: U7.15(PA1) U16.3(A2)
TIM2_DIR: U7.11(PC3) U16.5(DIR)
TIM3_CH3: U7.39(PC8) U20.3(A)
TIM3_DIR: U7.40(PC9) U20.5(DIR)
TIM8_CH1: R57.1 U7.37(PC6) U26.2(A1)
TIM8_CH1N: R56.1 U7.23(PA7) U26.3(A2)
TIM8_CH2: R55.1 U7.38(PC7) U27.2(A1)
TIM8_CH2N: R42.1 U7.26(PB0) U27.3(A2)
TJC_RXD: CN3.3 U7.16(PA2)
TJC_TXD: CN3.2 U7.17(PA3)
TMS: P1.7 U7.46(PA13)
TXN: J1.2(TD-) R11.2 U2.1(TXN)
TXP: J1.1(TD+) R10.2 U2.2(TXP)
USART1_RX: H1.4 U7.43(PA10)
USART1_TX: H1.3 U7.42(PA9)
USB_RXD: H1.1 U5.7(RXD)
USB_TXD: H1.2 U5.6(TXD)
W5500_XI: C28.2 R28.1 U2.30(XI/CLKIN) X3.1(OSC1)
W5500_XO: C27.1 R28.2 U2.31(XO) X3.3(OSC2)
WK_+1.2V: C24.2 U2.22(1V2O)
WK_+3.3A: C17.1 C21.2 C22.2 R10.1 R11.1 R14.1 R32.2 R33.2 R34.2 U2.4(AVDD) U2.8(AVDD) U2.11(AVDD) U2.15(AVDD) U2.17(AVDD) U2.21(AVDD) U13.1
WK_+3.3D: C14.2 C53.1 R8.1 R9.1 R19.2 R20.2 R21.2 U2.28(VDD) U12.2(VOUT(TAB)) U12.4(TAB) U13.2
WK_/INT: R20.1 U2.36(INTn) U7.25(PC5)
WK_/RESET: R21.1 U2.37(RSTn) U7.24(PC4)
WK_SPI_IO: R19.1 U2.34(MISO) U7.52(PC11)
WK_SPI_OI: U2.35(MOSI) U7.53(PC12)
WK_SPI_SCL: U2.33(SCLK) U7.51(PC10)
WK_SPI_SCS: U2.32(SCSn) U7.54(PD2)
$1N3180: B1.2 U10.8(VCC1)
$1N3382: U5.2(UD-) USB1.2(D-)
$1N3387: U5.1(UD+) USB1.3(D+)
$1N7315: C46.2 C54.2 L4.2 U7.13(VDDA/VREF+)
$1N7431: C45.2 U7.30(VCAP_1)
$1N10186: R52.1 U7.9(PC1)
$1N10224: LED2.2(A) R52.2
$1N11393: U10.2(X1) X2.1(OSC1)
$1N11396: U10.3(X2) X2.2(OSC2)
$1N12725: CN13.2 R59.1 U28.7(B)
$1N12726: CN13.1 R58.1 U28.6(A)
$2N734: U14.6(UD+) USB2.3(D+)
$2N737: U14.7(UD-) USB2.2(D-)
$3N345: J1.9 R8.2
$3N384: J1.12 R9.2
$3N1454: R17.2 U2.10(EXRES1)
$3N1489: C23.2 U2.20(TOCAP)
$3N1750: R18.2 U2.23(RSVD)
$3N2011: R22.1 U2.38(RSVD)
$3N2050: R23.1 U2.39(RSVD)
$3N2089: R24.1 U2.40(RSVD)
$3N2128: R25.1 U2.41(RSVD)
$3N2230: R26.1 U2.42(RSVD)
$4N379: C1.2 U11.1(BOOT)
$4N848: C1.1 D1.1(K) L1.1 U11.8(PH)
$4N975: R1.1 R2.2 U11.4(VSENSE)
$4N2391: C37.1 C38.1 D2.2(A) L2.2
$4N2465: C36.2 CN4.1 L2.1 LED1.2(A)
$4N2476: C36.1 CN4.2 L2.4 R51.1
$4N3697: LED1.1(K) R51.2
$5N685: R45.1 U21.1(AN)
$5N848: R47.1 U22.1(AN)
$5N1008: R49.1 U23.1(AN)
$5N1278: CN12.1 U16.7(B1)
$5N1282: CN12.2 U16.6(B2)
$5N1287: CN12.3 U20.4(B)
$6N344: CN2.1 U9.6(B2)
$6N345: CN1.1 U9.7(B1)
$6N346: SW1.2 U9.8(VCCB)
$6N3931: R53.2 U26.5(DIR)
$6N3975: R54.2 U27.5(DIR)

Not connected (* = marked no-connect by the designer): J1 7(NC)* 8(CHS GND)*; P1 11* 17* 19*; U2 7(DNC)* 12(NC)* 13(NC)* 18(VBG)* 24(SPDLED)* 26(DUPLED)* 46(NC)* 47(NC)*; U5 4(RTS#)*; U7 1(VBAT)* 2(PC13)* 3(PC14-OSC32_IN)* 4(PC15-OSC32_OUT)* 8(PC0)* 60(BOOT0)* 61(PB8)* 62(PB9)*; U11 2(NC)* 3(NC)* 5(ENA)*; U14 4(A0)* 10(D0)* 11(D1)* 12(D2)* 14(D4)*; USB1 4(ID)*

## Notes on the sheets
sheet 1
- I2C1_SDA
- I2C1_SCL
- SPI3_MOSI
- SPI3_MISO
- SPI3_SCK
- USART1_RX
- USART1_TX
- PC8  TIM3_CH3
- PC7  TIM8_CH2
- PC6  TIM8_CH1
- SPI2_MOSI
- SPI2_MISO
- SPI2_SCK
- USART2_TX
- SPI2_NSS
- USART2_RX
- PA15
- PB4
- PA13
- PA14
- PA7 TIM8_CH1N
- PB0  TIM8_CH2N
- PB3
sheet 6
- 脉冲的输入和输出
